# EasyEDA Pro project 嵌入式.eprj, board 6612
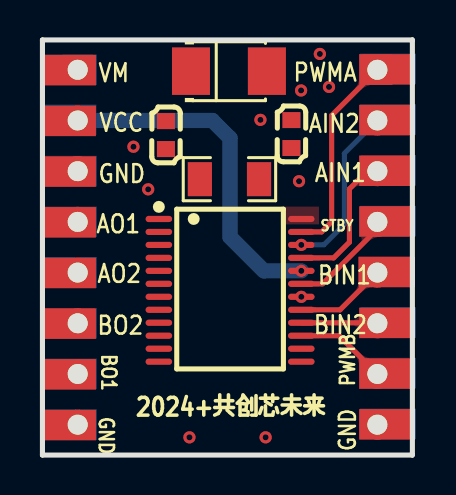
[diagram p8: board, top side]
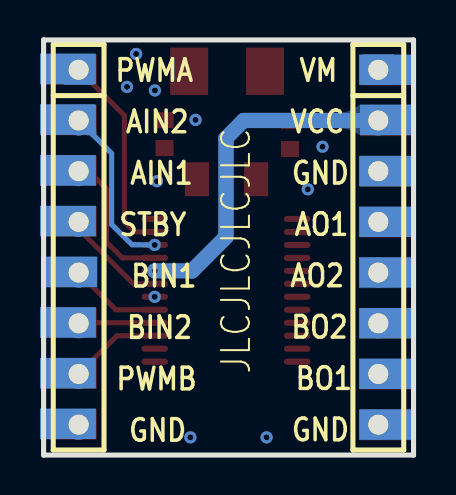
[diagram p9: board, bottom side, seen from below]

Outline 18.5 x 20.8 mm; copper layers: Top Layer, Bottom Layer. Coordinates in mm from the lower left corner of the outline.
Outline path: 0,20.8 18.5,20.8 18.5,0 0,0 0,20.8
Stack: Top Layer 0.035mm / Dielectric1 1.51mm FR4 er 4.5 / Bottom Layer 0.035mm

## Design rules (mm)
template: 自定义配置
spacing copperThickness1oz (default): track to track 0.102, other pairs 0.152 to 0.3
spacing copperThickness2oz: track to track 0.203, other pairs 0.152 to 0.3
track width copperThickness1oz (default): min 0.127, default 0.254, max 2.54
track width copperThickness2oz: min 0.203, default 0.254, max 2.54
differential pair differentialPair (default): width min 0.127, default 0.254, max 2.54; gap min 0.152, default 0.152
via viaSize (default): diameter min 0.5, default 0.61, max 10; hole min 0.3, default 0.305, max 6.3

## Placement (name value [footprint] x y rotation side)
C3  100nF  [C0603]  6.18 16.03 270 top
C4  100nF  [C0603]  12.45 16.08 270 top
C5  10uF  [CAP-SMD_L3.5-W2.8-R-RD]  9.33 19.23 180 top
H1  KH-2.54PH180-1X8P-L11.5  [HDR-TH_8P-P2.54-V-M]  16.75 10.41 270 bottom
H2  KH-2.54PH180-1X8P-L11.5  [HDR-TH_8P-P2.54-V-M]  1.76 10.41 270 bottom
NOREF  -  [Pad_e162]  1.32 4.07 0 top
NOREF#2  -  [Pad_e171]  17.28 1.56 180 top
NOREF#3  -  [Pad_e139]  1.27 16.74 0 top
NOREF#4  -  [Pad_e160]  1.32 9.15 0 top
NOREF#5  -  [Pad_e145]  1.27 11.66 0 top
NOREF#6  -  [Pad_e161]  1.32 6.61 0 top
NOREF#7  -  [Pad_e156]  17.24 1.54 180 top
NOREF#8  -  [Pad_e146]  1.27 6.58 0 top
NOREF#9  -  [Pad_e143]  1.27 14.2 0 top
NOREF#10  -  [Pad_e163]  1.32 1.53 0 top
NOREF#11  -  [Pad_e152]  17.24 11.7 180 top
NOREF#12  -  [Pad_e154]  17.24 6.62 180 top
NOREF#13  -  [Pad_e173]  1.3 16.79 0 top
NOREF#14  -  [Pad_e164]  17.28 19.35 180 top
NOREF#15  -  [Pad_e158]  1.32 14.23 0 top
NOREF#16  -  [Pad_e169]  17.28 6.65 180 top
NOREF#17  -  [Pad_e149]  17.24 19.32 180 top
NOREF#18  -  [Pad_e170]  17.28 4.11 180 top
NOREF#19  -  [Pad_e153]  17.2 9.17 180 top
NOREF#20  -  [Pad_e147]  1.27 4.04 0 top
NOREF#21  -  [Pad_e167]  17.28 11.73 180 top
NOREF#22  -  [Pad_e155]  17.24 4.08 180 top
NOREF#23  -  [Pad_e157]  1.32 19.31 0 top
NOREF#24  -  [Pad_e166]  17.28 14.27 180 top
NOREF#25  -  [Pad_e150]  17.24 16.78 180 top
NOREF#26  -  [Pad_e168]  17.23 9.17 180 top
NOREF#27  -  [Pad_e165]  17.28 16.81 180 top
NOREF#28  -  [Pad_e144]  1.27 9.12 0 top
NOREF#29  -  [Pad_e140]  1.27 19.28 0 top
NOREF#30  -  [Pad_e148]  1.27 1.5 0 top
NOREF#31  -  [Pad_e159]  1.32 11.69 0 top
NOREF#32  -  [Pad_e151]  17.24 14.24 180 top
R1  0Ω  [R1206]  9.35 13.82 0 top
U2  TB6612FNG  [SSOP-24_L8.3-W5.6-P0.65-LS7.6-BL]  9.38 8.25 270 top

## Footprints (pads in the part's own frame, mm; a bottom-side part is the same pattern mirrored in y, then rotated)
C0603
  rect 0.8x0.9 smd: 1(-0.7,0) 2(0.7,0)
CAP-SMD_L3.5-W2.8-R-RD
  rect 1.9x2.376 smd: 1(1.899,0) 2(-1.899,0)
HDR-TH_8P-P2.54-V-M
  rect 1.5x1.5 hole 1: 1(-8.89,0)
  round 1.5 hole 1: 2(-6.35,0) 3(-3.81,0) 4(-1.27,0) 5(1.27,0) 6(3.81,0) 7(6.35,0) 8(8.89,0)
Pad_e139
  rect 2.794x1.524 smd: 25(0,0)
Pad_e140
  rect 2.794x1.524 smd: 25(0,0)
Pad_e143
  rect 2.794x1.524 smd: 25(0,0)
Pad_e144
  rect 2.794x1.524 smd: 25(0,0)
Pad_e145
  rect 2.794x1.524 smd: 25(0,0)
Pad_e146
  rect 2.794x1.524 smd: 25(0,0)
Pad_e147
  rect 2.794x1.524 smd: 25(0,0)
Pad_e148
  rect 2.794x1.524 smd: 25(0,0)
Pad_e149
  rect 2.794x1.524 smd: 25(0,0)
Pad_e150
  rect 2.794x1.524 smd: 25(0,0)
Pad_e151
  rect 2.794x1.524 smd: 25(0,0)
Pad_e152
  rect 2.794x1.524 smd: 25(0,0)
Pad_e153
  rect 2.794x1.524 smd: 25(0,0)
Pad_e154
  rect 2.794x1.524 smd: 25(0,0)
Pad_e155
  rect 2.794x1.524 smd: 25(0,0)
Pad_e156
  rect 2.794x1.524 smd: 25(0,0)
Pad_e157
  rect 2.794x1.524 smd far side: 25(0,0)
Pad_e158
  rect 2.794x1.524 smd far side: 25(0,0)
Pad_e159
  rect 2.794x1.524 smd far side: 25(0,0)
Pad_e160
  rect 2.794x1.524 smd far side: 25(0,0)
Pad_e161
  rect 2.794x1.524 smd far side: 25(0,0)
Pad_e162
  rect 2.794x1.524 smd far side: 25(0,0)
Pad_e163
  rect 2.794x1.524 smd far side: 25(0,0)
Pad_e164
  rect 2.794x1.524 smd far side: 25(0,0)
Pad_e165
  rect 2.794x1.524 smd far side: 25(0,0)
Pad_e166
  rect 2.794x1.524 smd far side: 25(0,0)
Pad_e167
  rect 2.794x1.524 smd far side: 25(0,0)
Pad_e168
  rect 2.794x1.524 smd far side: 25(0,0)
Pad_e169
  rect 2.794x1.524 smd far side: 25(0,0)
Pad_e170
  rect 2.794x1.524 smd far side: 25(0,0)
Pad_e171
  rect 2.794x1.524 smd far side: 25(0,0)
Pad_e173
  rect 2.794x1.524 smd far side: 25(0,0)
R1206
  rect 1.208x1.701 smd: 1(-1.479,0) 2(1.479,0)
SSOP-24_L8.3-W5.6-P0.65-LS7.6-BL
  oval 0.308x1.324 smd: 1(-3.575,-3.562) 2(-2.925,-3.562) 3(-2.275,-3.562) 4(-1.625,-3.562) 5(-0.975,-3.562) 6(-0.325,-3.562) 7(0.325,-3.562) 8(0.975,-3.562) 9(1.625,-3.562) 10(2.275,-3.562) 11(2.925,-3.562) 12(3.575,-3.562) 13(3.575,3.562) 14(2.925,3.562) 15(2.275,3.562) 16(1.625,3.562) 17(0.975,3.562) 18(0.325,3.562) 19(-0.325,3.562) 20(-0.975,3.562) 21(-1.625,3.562) 22(-2.275,3.562) 23(-2.925,3.562) 24(-3.575,3.562)

## Nets
12V: C4.2 C5.1 H2.1 NOREF#23.25 NOREF#29.25 U2.13 U2.14 U2.24
GND: C3.2 C4.1 C5.2 H1.8 H2.3 H2.8 NOREF#2.25 NOREF#7.25 NOREF#9.25 NOREF#10.25 NOREF#15.25 NOREF#30.25 R1.1 R1.2 U2.3 U2.4 U2.9 U2.10 U2.18
VCC: C3.1 H2.2 NOREF#3.25 NOREF#13.25 U2.20
AIN1: H1.3 NOREF#24.25 NOREF#32.25 U2.21
AIN2: H1.2 NOREF#25.25 NOREF#27.25 U2.22
AO1: H2.4 NOREF#5.25 NOREF#31.25 U2.1 U2.2
AO2: H2.5 NOREF#4.25 NOREF#28.25 U2.5 U2.6
BIN1: H1.5 NOREF#19.25 NOREF#26.25 U2.17
BIN2: H1.6 NOREF#12.25 NOREF#16.25 U2.16
BO1: H2.7 NOREF.25 NOREF#20.25 U2.11 U2.12
BO2: H2.6 NOREF#6.25 NOREF#8.25 U2.7 U2.8
PWMA: H1.1 NOREF#14.25 NOREF#17.25 U2.23
PWMB: H1.7 NOREF#18.25 NOREF#22.25 U2.15
STBY: H1.4 NOREF#11.25 NOREF#21.25 U2.19

## Via types
v1: diameter 0.61, hole 0.305, Top Layer to Bottom Layer, 12 vias

## Routing (per net, layer and track width the routed paths; a pad name or vN(x,y) marks a point on that pad's centre or on a via; arc(x,y) is an arc through that point)
GND:
  vias: v1(4.55,15.45) v1(5.29,13.31) v1(7.35,0.89) v1(10.9,16.79) v1(11.16,0.89) v1(12.83,13.72) v1(12.93,18.27) v1(12.95,7.93) v1(13.87,20.1) v1(14.33,18.45)
VCC: length 17.2
  Bottom Layer w0.762: v1(12.95,9.23) 11.07,9.23 9.38,10.92 9.38,15.87 8.49,16.76 H2.2
AIN1: length 7.2
  Top Layer w0.254: H1.3 16.24,14.22 15.35,13.33 15.35,10.67 14.56,9.88 U2.21
AIN2: length 8.5
  Bottom Layer w0.254: 12.94,10.53 14.08,10.54 15.1,11.56 15.1,15.11 H1.2
  vias: v1(12.95,10.53)
BIN1: length 4.6
  Top Layer w0.254: U2.17 14.88,7.28 H1.5
BIN2: length 3.8
  Top Layer w0.254: U2.16 16.72,6.63 H1.6
PWMA: length 10.3
  Top Layer w0.254: 12.94,11.18 13.96,11.18 14.46,11.68 14.46,17.02 H1.1
PWMB: length 4.6
  Top Layer w0.254: U2.15 14.83,5.98 H1.7
STBY: length 5.3
  Top Layer w0.254: U2.19 14,8.58 16.75,11.32 H1.4

## Copper pours and planes (outline as drawn; the poured copper is in the pictures)
12V on Top Layer: 9.01,15.87 12.9,15.87 12.9,15 9.01,15
12V on Top Layer: 0,20.8 8.57,20.8 10.02,17.28 10.02,12.55 13.73,12.55 13.83,12.45 13.83,11.56 12.19,11.56 12.17,11.54 12.15,11.56 11,11.56 11,5.8 11.26,5.54 13.58,5.54 13.79,5.33 13.79,4.67 13.57,4.45 8.83,4.45 8.83,15.37 6.68,18 0,18
12V on Top Layer: 11.92,12.45 13.83,12.45 13.83,11.56 11.92,11.56
GND on Top Layer: 0,20.8 18.5,20.8 18.5,0 0,0
GND on Bottom Layer: 0,20.8 18.5,20.8 18.5,0 0,0
VCC on Top Layer: 0.49,17.25 6.63,17.25 6.63,16.31 0.49,16.31
AO1 on Top Layer: 6.48,11 0,11 0,12.38 -0.05,12.43 6.56,12.43 6.56,12.2 6.53,12.17 6.53,11.05
AO2 on Top Layer: 5.52,9.51 3.41,9.51 2.82,10.09 0,10.09 0,8.41 -0.05,8.36 6.41,8.36 6.56,8.51 6.56,9.45 6.48,9.53 5.54,9.53
BO1 on Top Layer: 4.59,5.53 3.94,4.88 0,4.88 0,3.13 0,3.13 6.33,3.13 6.61,3.41 6.61,5.44 6.69,5.52 6.67,5.53
BO2 on Top Layer: 5.54,8.13 6.38,8.13 6.58,7.93 6.58,7.19 6.41,7.02 3.46,7.02 3.43,6.99 3.43,6.48 2.77,5.82 0.06,5.82 0,5.87 0,8.08 -0.02,8.11 5.52,8.11

Small or netless copper shapes (teardrops, artwork), in the pictures only: 19 on Top Layer, 5 on Bottom Layer

## Text on the board
Bottom Silkscreen Layer: VM | BO1 | AO1 | GND | BO2 | VCC | AO2 | BIN1 | AIN1 | BIN2 | AIN2 | STBY | PWMB | PWMA | JLCJLCJLCJLC
Top Silkscreen Layer: STBY | PWMB | GND | BO1 | AO1 | AO2 | BO2 | VM | VCC | PWMA | AIN2 | BIN2 | AIN1 | BIN1 | 2024+共创芯未来
